# EasyEDA Pro project ProPrj_Starcat_FOC双路矢量控制器_2024-11-11.epro, schematic FOC_cdh_3

## Sheets
1 control: Board Name: 双路大功率矢量控制器_改动版; Create Date: 2024-07-31; Page Name: control; Project Name: Starcat_FOC双路矢量控制器; Schematic Name: FOC_cdh_3; Update Date: 2024-09-01
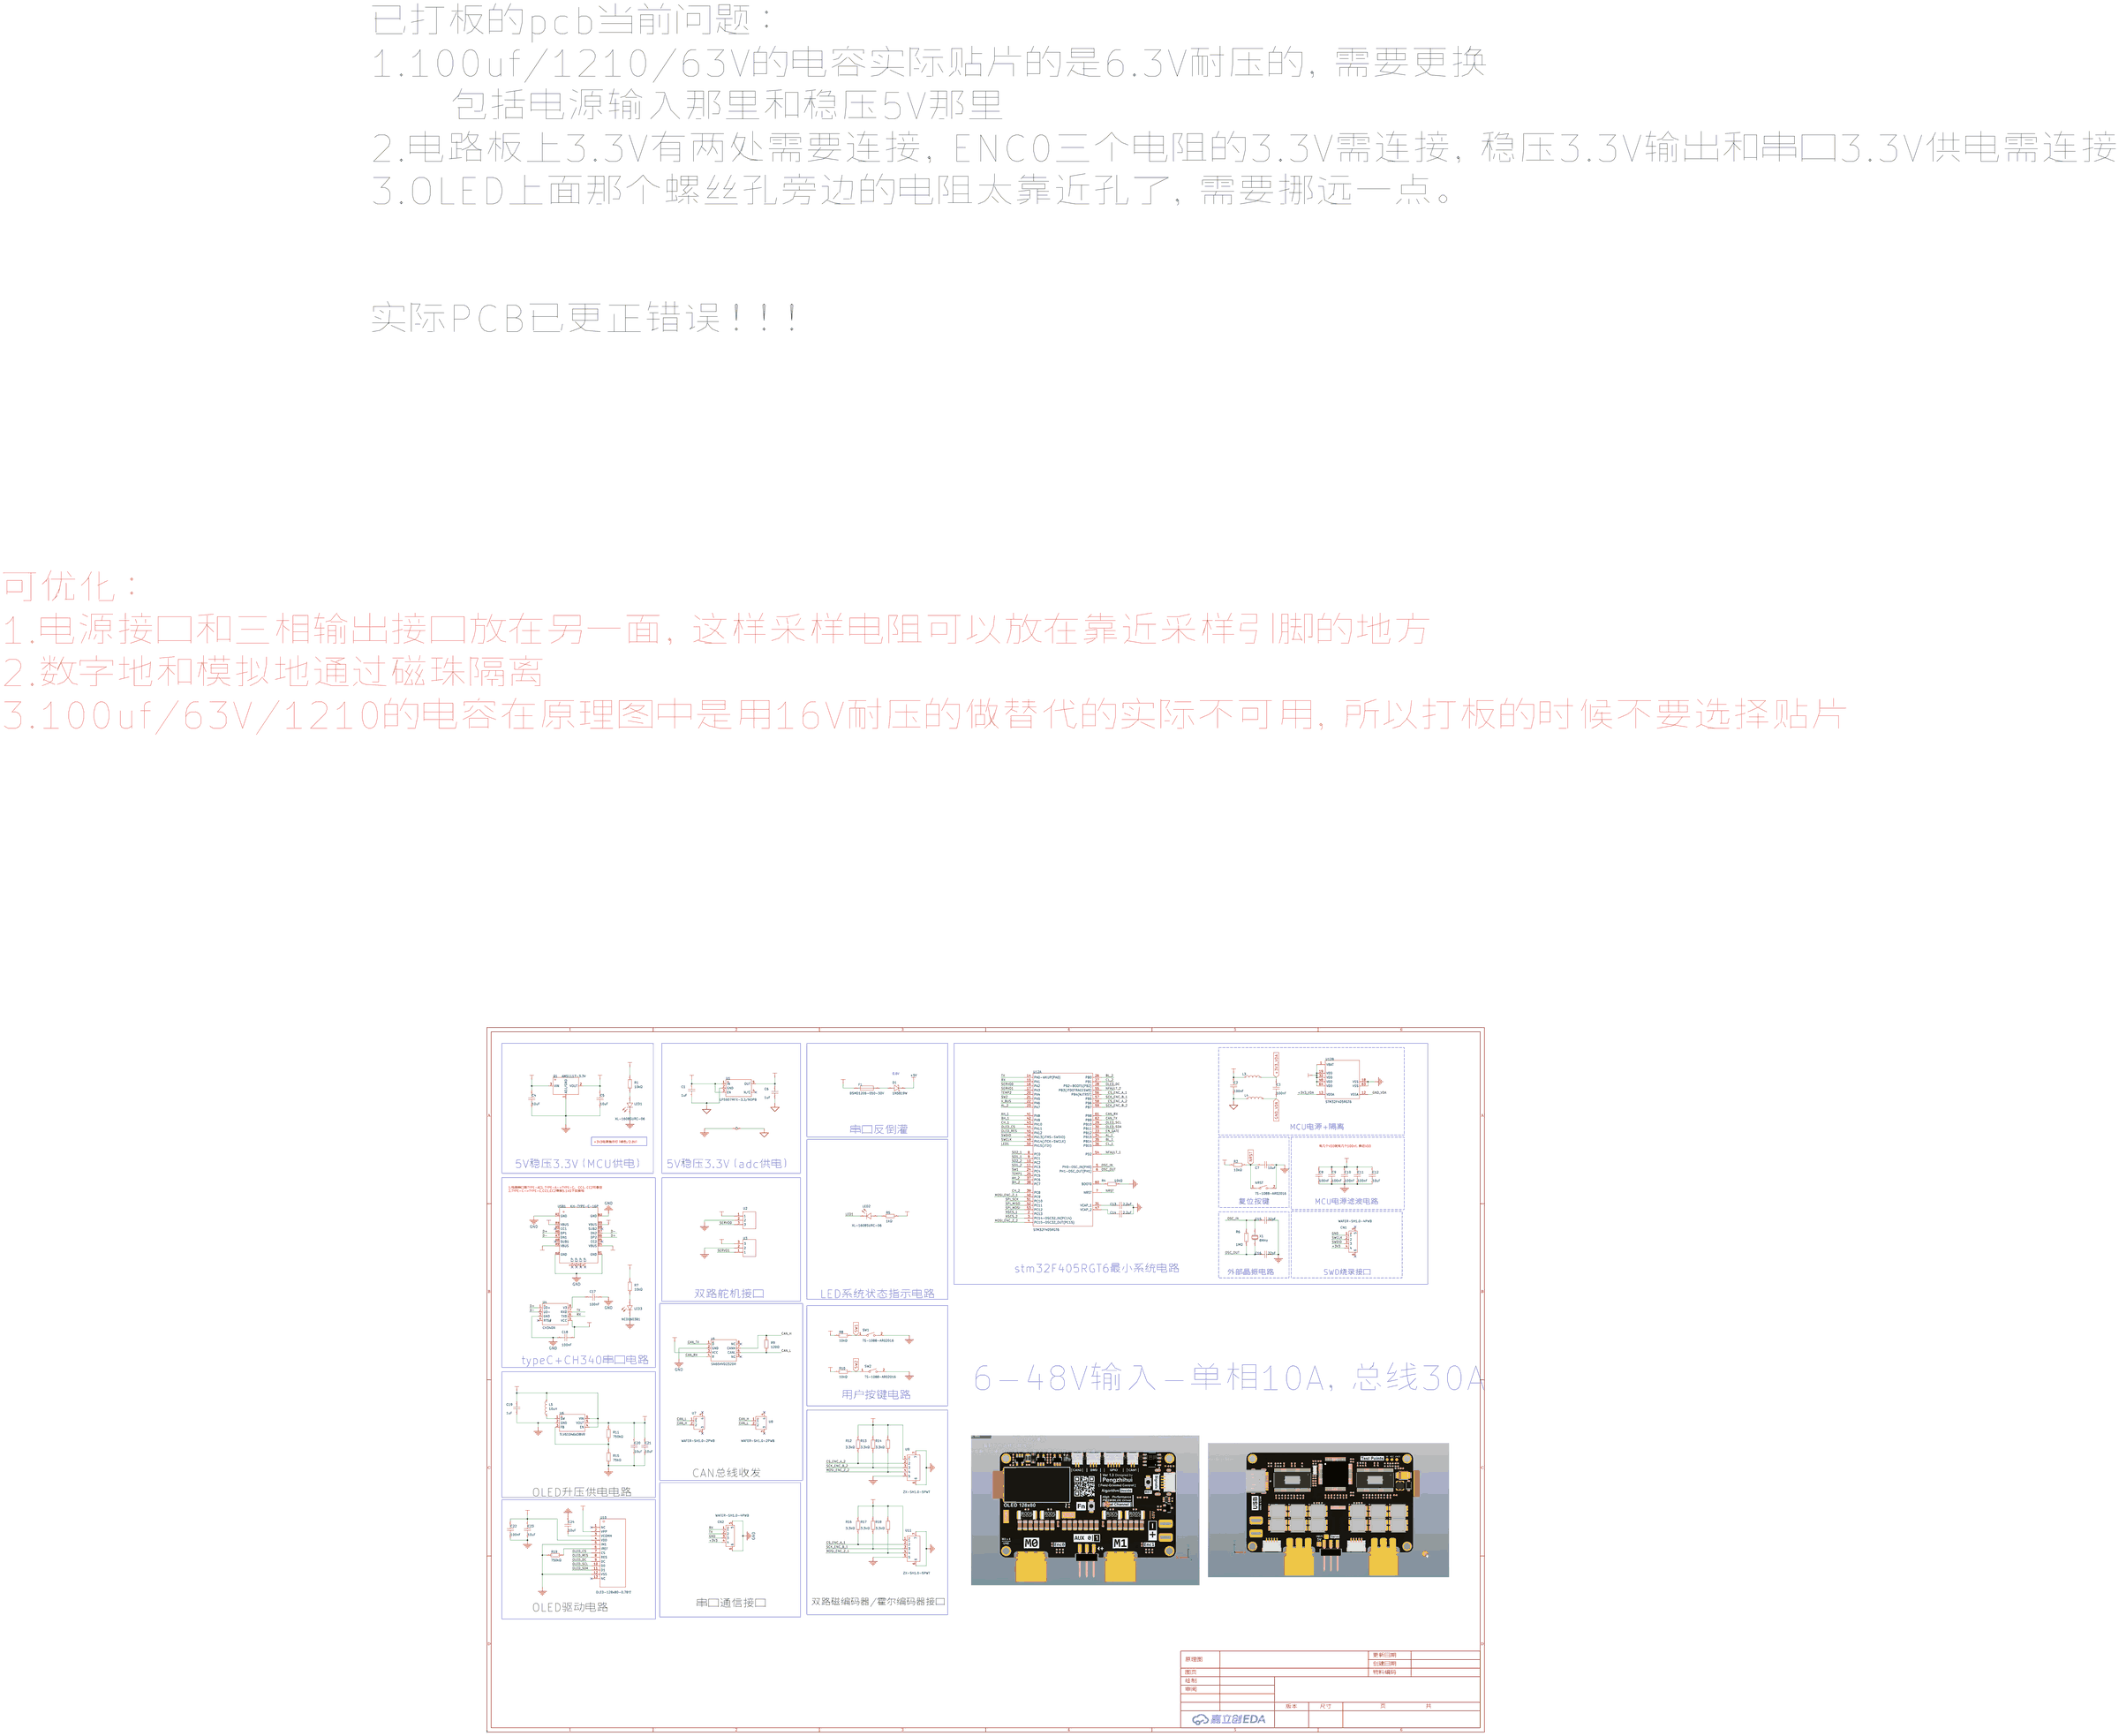
[diagram p3: control]
2 driver: Page Name: driver; Update Date: 2024-08-25
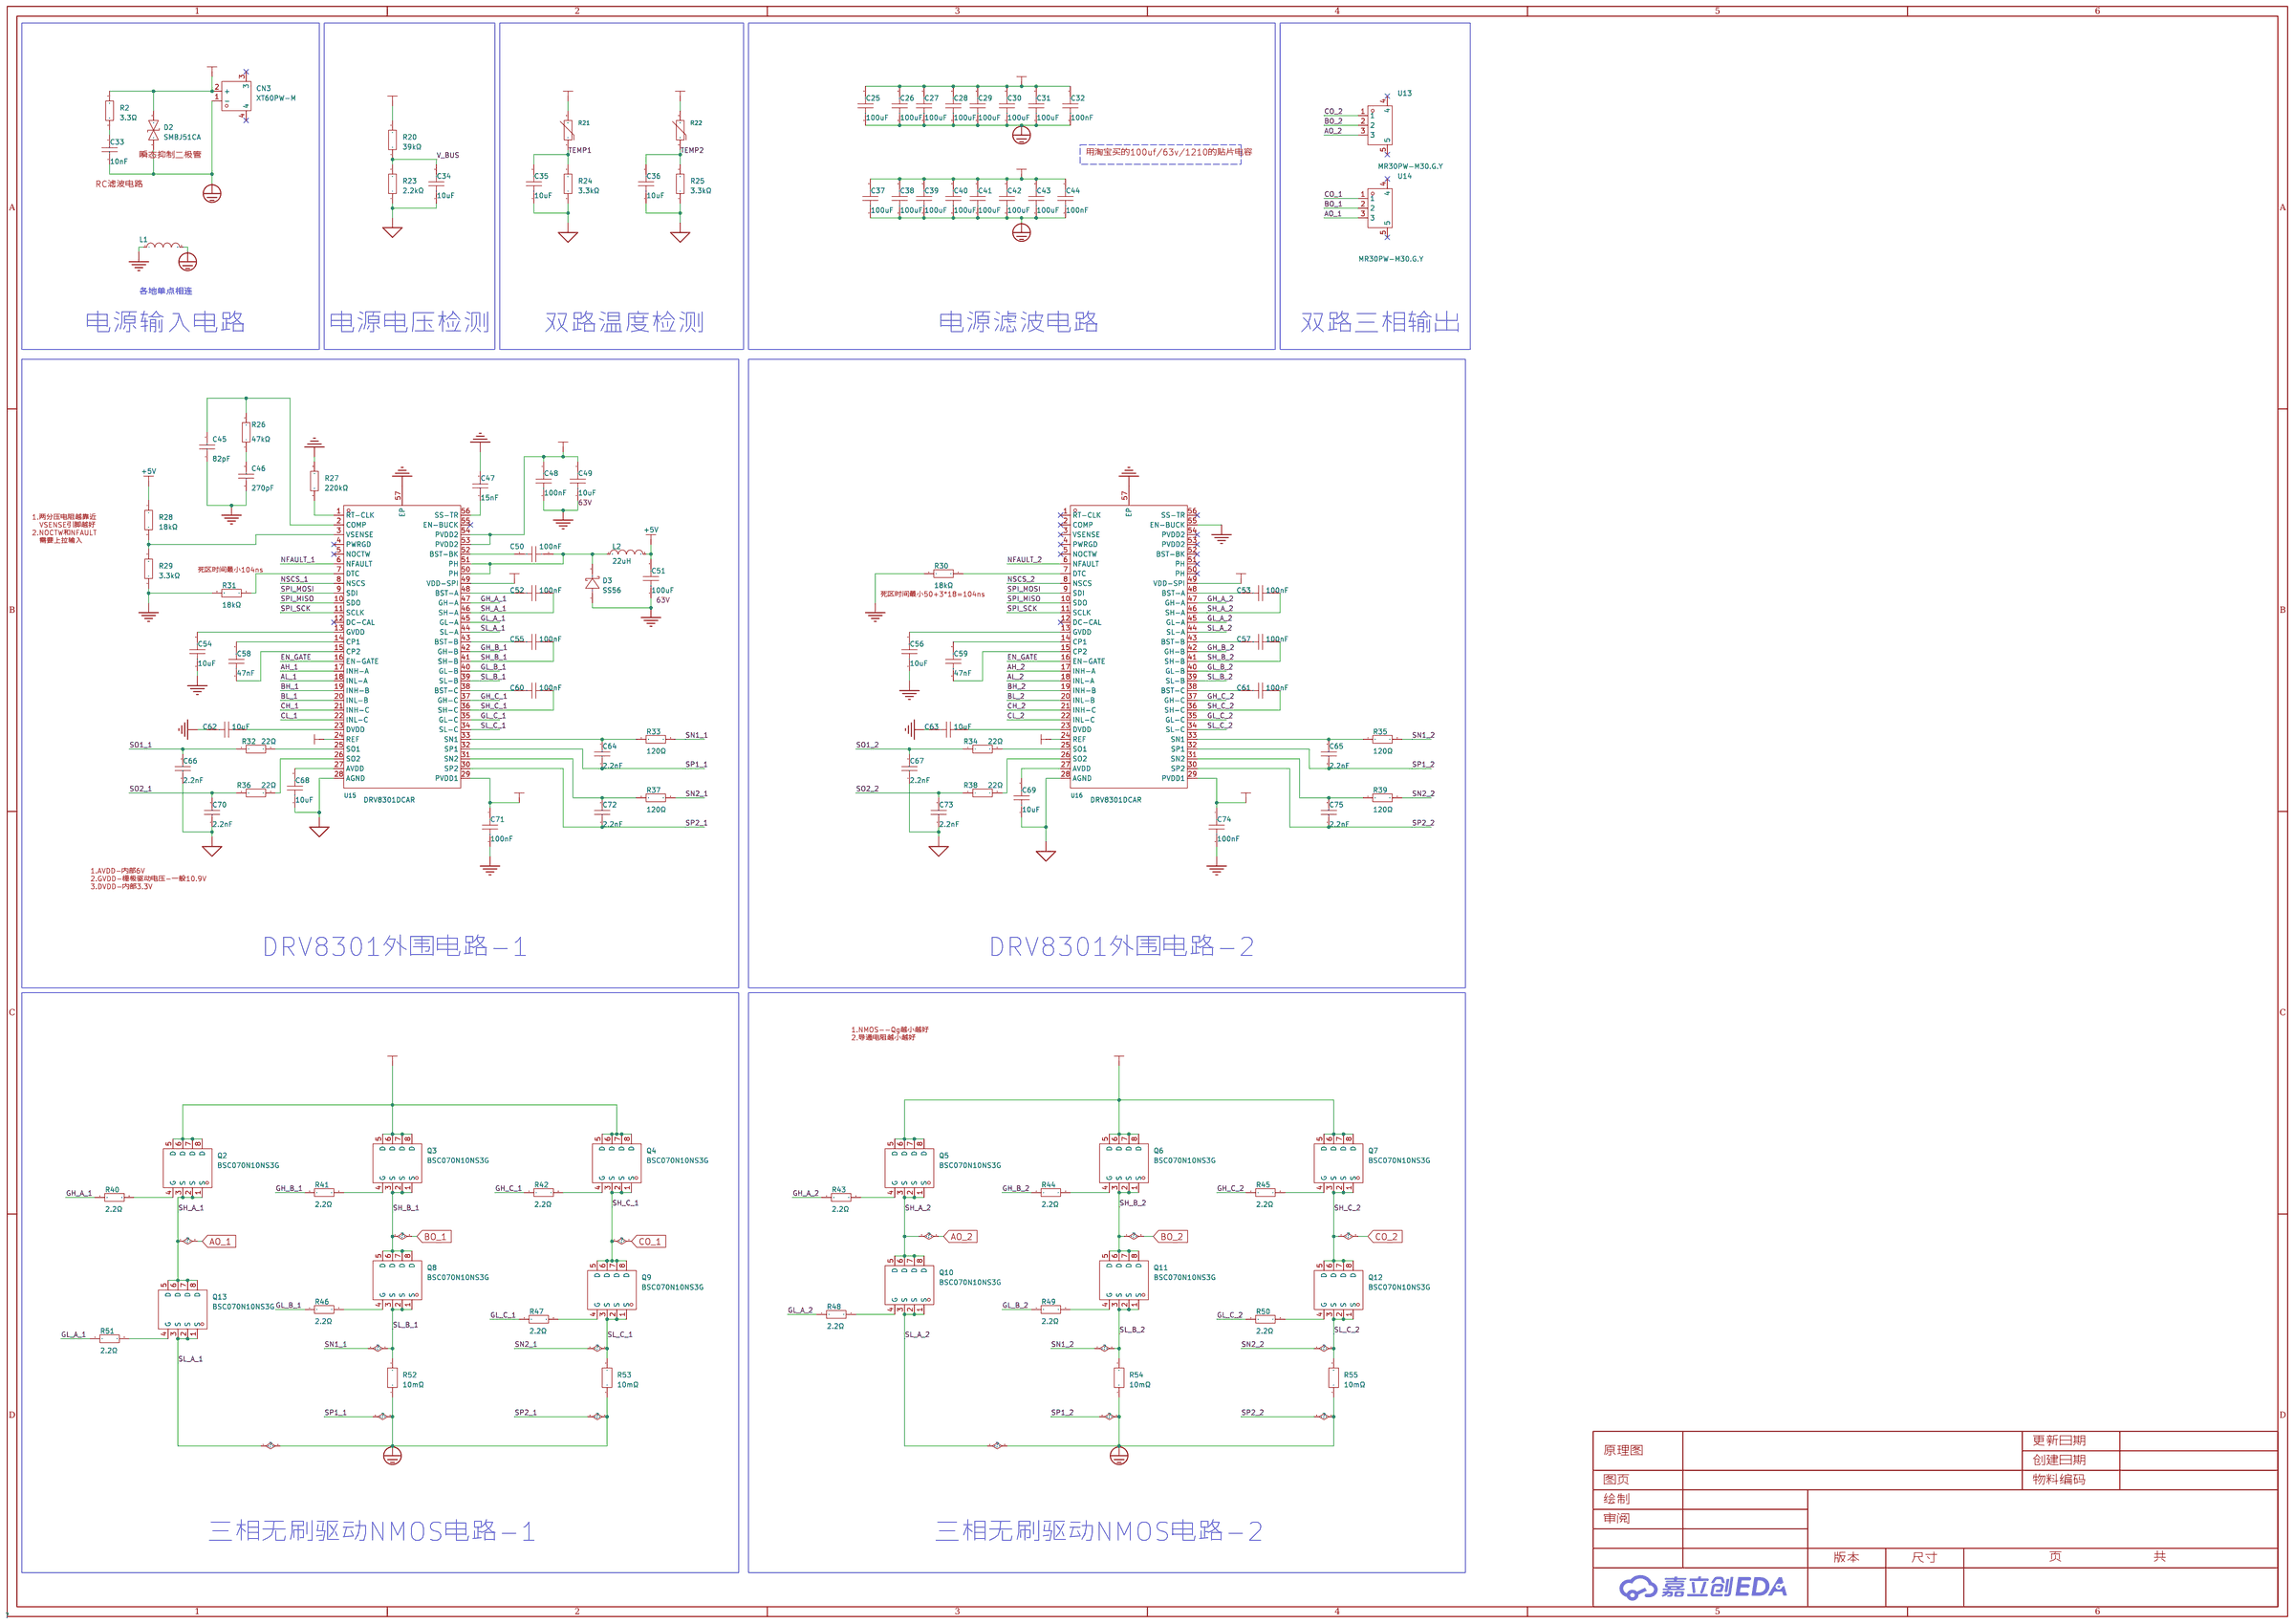
[diagram p4: driver]

## Parts
sheet control
C1  1uF  [C0603]
C2  100nF  [C0603]
C3  100nF  [C0603]
C4  10uF  [C0603]
C5  10uF  [C0603]
C6  1uF  [C0603]
C7  10uF  [C0603]
C8  100nF  [C0603]
C9  100nF  [C0603]
C10  100nF  [C0603]
C11  100nF  [C0603]
C12  10uF  [C0603]
C13  2.2uF  [C0603]
C14  2.2uF  [C0603]
C15  22pF  [C0603]
C16  22pF  [C0603]
C17  100nF  [C0603]
C18  100nF  [C0603]
C19  1uF  [C0603]
C20  10uF  [C0603]
C21  10uF  [C0603]
C22  100nF  [C0603]
C23  10uF  [C0603]
C24  10uF  [C0603]
CN1  WAFER-SH1.0-4PWB  [CONN-SMD_4P-P1.00_WAFER-SH1.0-4PWB]
CN2  WAFER-SH1.0-4PWB  [CONN-SMD_4P-P1.00_WAFER-SH1.0-4PWB]
D1  1N5819W  [SOD-123_L2.7-W1.6-LS3.7-R-RD]
F1  BSMD1206-050-30V  [F1206]
L3  CBG160808U000T  [L0603]
L4  CBG160808U000T  [L0603]
L5  10uH  [L0805]
LED1  XL-1608SURC-06  [LED0603-RD_RED]
LED2  XL-1608SURC-06  [LED0603-RD_RED]
LED3  NCD0603B1  [LED0603-RD]
NRST  TS-1088-AR02016  [SW-SMD_L3.9-W3.0-P4.45]
Q1  AMS1117-3.3V  [SOT-89-3_L4.5-W2.5-P1.50-LS4.2-BR]
R1  10kΩ  [R0603]
R3  10kΩ  [R0603]
R4  10kΩ  [R0603]
R5  1kΩ  [R0603]
R6  1MΩ  [R0603]
R7  10kΩ  [R0603]
R8  10kΩ  [R0603]
R9  120Ω  [R0603]
R10  10kΩ  [R0603]
R11  750kΩ  [R0603]
R12  3.3kΩ  [R0603]
R13  3.3kΩ  [R0603]
R14  3.3kΩ  [R0603]
R15  75kΩ  [R0603]
R16  3.3kΩ  [R0603]
R17  3.3kΩ  [R0603]
R18  3.3kΩ  [R0603]
R19  750kΩ  [R0603]
SW1  TS-1088-AR02016  [SW-SMD_L3.9-W3.0-P4.45]
SW2  TS-1088-AR02016  [SW-SMD_L3.9-W3.0-P4.45]
U1  LP5907MFX-3.3/NOPB  [SOT-23-5_L3.0-W1.7-P0.95-LS2.8-BR]
U2  -  [3p排针 贴片]
U3  -  [3p排针 贴片]
U4  CH340N  [SOP-8_L4.9-W3.9-P1.27-LS6.0-BL]
U5  SN65HVD232DR  [SOIC-8_L5.0-W4.0-P1.27-LS6.0-BL]
U6  TLV61046ADBVR  [SOT-23-6_L2.9-W1.6-P0.95-LS2.8-BL]
U7  WAFER-SH1.0-2PWB  [CONN-SMD_2P-P1.00_XUNPU_WAFER-SH1.0-2PWB]
U8  WAFER-SH1.0-2PWB  [CONN-SMD_2P-P1.00_XUNPU_WAFER-SH1.0-2PWB]
U9  ZX-SH1.0-5PWT  [CONN-SMD_5P-P1.00_MEGASTAR_ZX-SH1.0-5PWT]
U10  OLED-128x80-0.78寸  [oled-128x80-0.78寸]
U11  ZX-SH1.0-5PWT  [CONN-SMD_5P-P1.00_MEGASTAR_ZX-SH1.0-5PWT]
U12  STM32F405RGT6  [LQFP-64_L10.0-W10.0-P0.50-LS12.0-BL]  (sections 1,2)
USB1  KH-TYPE-C-16P  [USB-C-SMD_KH-TYPE-C-16P]
X1  8MHz  [CRYSTAL-SMD_L5.0-W3.2]
sheet driver
C25  100uF  [C1210]
C26  100uF  [C1210]
C27  100uF  [C1210]
C28  100uF  [C1210]
C29  100uF  [C1210]
C30  100uF  [C1210]
C31  100uF  [C1210]
C32  100nF  [C0603]
C33  10nF  [C0603]
C34  10uF  [C0603]
C35  10uF  [C0603]
C36  10uF  [C0603]
C37  100uF  [C1210]
C38  100uF  [C1210]
C39  100uF  [C1210]
C40  100uF  [C1210]
C41  100uF  [C1210]
C42  100uF  [C1210]
C43  100uF  [C1210]
C44  100nF  [C0603]
C45  82pF  [C0603]
C46  270pF  [C0603]
C47  15nF  [C0603]
C48  100nF  [C0603]
C49  10uF  [C0805]
C50  100nF  [C0603]
C51  100uF  [C1210]
C52  100nF  [C0603]
C53  100nF  [C0603]
C54  10uF  [C0603]
C55  100nF  [C0603]
C56  10uF  [C0603]
C57  100nF  [C0603]
C58  47nF  [C0603]
C59  47nF  [C0603]
C60  100nF  [C0603]
C61  100nF  [C0603]
C62  10uF  [C0603]
C63  10uF  [C0603]
C64  2.2nF  [C0603]
C65  2.2nF  [C0603]
C66  2.2nF  [C0603]
C67  2.2nF  [C0603]
C68  10uF  [C0603]
C69  10uF  [C0603]
C70  2.2nF  [C0603]
C71  100nF  [C0603]
C72  2.2nF  [C0603]
C73  2.2nF  [C0603]
C74  100nF  [C0603]
C75  2.2nF  [C0603]
CN3  XT60PW-M  [CONN-TH_XT60PW-M]
D2  SMBJ51CA  [SMB_L4.4-W3.6-LS5.4-BI]
D3  SS56  [SMA_L4.3-W2.6-LS5.0-FD]
L1  CBG160808U000T  [L0603]
L2  22uH  [IND-SMD_L4.0-W4.0]
Q2  BSC070N10NS3G  [PG-TDSON-8_L5.0-W6.0-P1.27-BL-EP]
Q3  BSC070N10NS3G  [PG-TDSON-8_L5.0-W6.0-P1.27-BL-EP]
Q4  BSC070N10NS3G  [PG-TDSON-8_L5.0-W6.0-P1.27-BL-EP]
Q5  BSC070N10NS3G  [PG-TDSON-8_L5.0-W6.0-P1.27-BL-EP]
Q6  BSC070N10NS3G  [PG-TDSON-8_L5.0-W6.0-P1.27-BL-EP]
Q7  BSC070N10NS3G  [PG-TDSON-8_L5.0-W6.0-P1.27-BL-EP]
Q8  BSC070N10NS3G  [PG-TDSON-8_L5.0-W6.0-P1.27-BL-EP]
Q9  BSC070N10NS3G  [PG-TDSON-8_L5.0-W6.0-P1.27-BL-EP]
Q10  BSC070N10NS3G  [PG-TDSON-8_L5.0-W6.0-P1.27-BL-EP]
Q11  BSC070N10NS3G  [PG-TDSON-8_L5.0-W6.0-P1.27-BL-EP]
Q12  BSC070N10NS3G  [PG-TDSON-8_L5.0-W6.0-P1.27-BL-EP]
Q13  BSC070N10NS3G  [PG-TDSON-8_L5.0-W6.0-P1.27-BL-EP]
R2  3.3Ω  [R0603]
R20  39kΩ  [R0603]
R21  NCP18XH103F03RB  [R0603]
R22  NCP18XH103F03RB  [R0603]
R23  2.2kΩ  [R0603]
R24  3.3kΩ  [R0603]
R25  3.3kΩ  [R0603]
R26  47kΩ  [R0603]
R27  220kΩ  [R0603]
R28  18kΩ  [R0603]
R29  3.3kΩ  [R0603]
R30  18kΩ  [R0603]
R31  18kΩ  [R0603]
R32  22Ω  [R0603]
R33  120Ω  [R0603]
R34  22Ω  [R0603]
R35  120Ω  [R0603]
R36  22Ω  [R0603]
R37  120Ω  [R0603]
R38  22Ω  [R0603]
R39  120Ω  [R0603]
R40  2.2Ω  [R0603]
R41  2.2Ω  [R0603]
R42  2.2Ω  [R0603]
R43  2.2Ω  [R0603]
R44  2.2Ω  [R0603]
R45  2.2Ω  [R0603]
R46  2.2Ω  [R0603]
R47  2.2Ω  [R0603]
R48  2.2Ω  [R0603]
R49  2.2Ω  [R0603]
R50  2.2Ω  [R0603]
R51  2.2Ω  [R0603]
R52  10mΩ  [RES-SMD_L6.4-W3.2-R2512]
R53  10mΩ  [RES-SMD_L6.4-W3.2-R2512]
R54  10mΩ  [RES-SMD_L6.4-W3.2-R2512]
R55  10mΩ  [RES-SMD_L6.4-W3.2-R2512]
U13  MR30PW-M30.G.Y  [CONN-TH_MR30PW-M30-G-Y]
U14  MR30PW-M30.G.Y  [CONN-TH_MR30PW-M30-G-Y]
U15  DRV8301DCAR  [HTSSOP-56_L14.0-W6.0-P0.50-LS8.0-BL]
U16  DRV8301DCAR  [HTSSOP-56_L14.0-W6.0-P0.50-LS8.0-BL]

## Library data of the parts
C1 C6 C19 = CL10A105KB8NNNC: 容值:1uF;精度:±10%;额定电压:50V;材质(温度系数):X5R;; LCSC Part Name: 1uF ±10% 50V; Supplier Part: C15849; Manufacturer: SAMSUNG(三星); Supplier Footprint: 0603; JLCPCB Part Class: 基础库; Datasheet: https://atta.szlcsc.com/upload/public/pdf/source/20160218/1457707763339.pdf; Supplier: LCSC; Tolerance: ±10%; Voltage Rated: 50V; Temperature Coefficient: X5R
C2 C3 C8-C11 C17 C18 C22 C32 C44 C48 C50 C52 C53 C55 C57 C60 C61 C71 C74 = 0603B104K101NT: 容值:100nF;精度:±10%;额定电压:100V;材质(温度系数):X7R;; LCSC Part Name: 100nF ±10% 100V; Supplier Part: C88219; Manufacturer: FH(风华); Supplier Footprint: 0603; JLCPCB Part Class: 扩展库; Datasheet: https://atta.szlcsc.com/upload/public/pdf/source/20200305/C486355_26A10D38EF8C2A5C37091D0039909270.pdf; Supplier: LCSC; Tolerance: ±10%; Voltage Rated: 100V; Temperature Coefficient: X7R
C4 C5 C7 C12 C20 C21 C23 C24 C34-C36 C54 C56 C62 C63 C68 C69 = CL10A106MA8NRNC: 容值:10uF;精度:±20%;额定电压:25V;材质(温度系数):X5R;; LCSC Part Name: 10uF ±20% 25V; Supplier Part: C96446; Manufacturer: SAMSUNG(三星); Supplier Footprint: 0603; JLCPCB Part Class: 基础库; Datasheet: https://atta.szlcsc.com/upload/public/pdf/source/20160218/1457707763339.pdf; Supplier: LCSC; Tolerance: ±20%; Voltage Rated: 25V; Temperature Coefficient: X5R
C13 C14 = CL10A225KQ8NNNC: 容值:2.2uF;精度:±10%;额定电压:6.3V;材质(温度系数):X5R;; LCSC Part Name: 2.2uF ±10% 6.3V; Supplier Part: C71000; Manufacturer: SAMSUNG(三星); Supplier Footprint: 0603; JLCPCB Part Class: 扩展库; Datasheet: https://atta.szlcsc.com/upload/public/pdf/source/20191106/C444885_D1DE823F0ED498E02883F0194C396E9C.pdf; Supplier: LCSC; Tolerance: ±10%; Voltage Rated: 6.3V; Temperature Coefficient: X5R
C15 C16 = CL10C220JB8NNNC: 容值:22pF;精度:±5%;额定电压:50V;材质(温度系数):C0G;; LCSC Part Name: 22pF ±5% 50V; Supplier Part: C1653; Manufacturer: SAMSUNG(三星); Supplier Footprint: 0603; JLCPCB Part Class: 基础库; Datasheet: https://atta.szlcsc.com/upload/public/pdf/source/20160218/1457707763339.pdf; Supplier: LCSC; Tolerance: ±5%; Voltage Rated: 50V; Temperature Coefficient: C0G
CN1 CN2 = WAFER-SH1.0-4PWB: 插针结构:1x4P;间距:1mm;安装方式:卧贴;总PIN数:4P;排数:1;每排PIN数:4;额定电流:1A;工作温度范围:-25℃~+85℃;; LCSC Part Name: 1x4P 间距:1mm 卧贴; Supplier Part: C3029343; Manufacturer: XUNPU(讯普); Supplier Footprint: SMD,P=1mm,卧贴; JLCPCB Part Class: 扩展库; Datasheet: https://atta.szlcsc.com/upload/public/pdf/source/20220527/1879B8210BD3B2006BCEAC1A40D397B6.pdf; Supplier: LCSC; Pins Structure: 1x4P; Pitch: 1mm; Mounting Style: 卧贴; Number of Pins: 4P; Number of Rows: 1; Number of PINs Per Row: 4; Current Rating (Max): 1A; Operating Temperature Range: -25℃~+85℃
D1 = 1N5819W_C963381: 二极管配置:独立式;正向压降(Vf):600mV@200mA;直流反向耐压(Vr):40V;平均整流电流(Io):350mA;; LCSC Part Name: 电压:40V 电流:350mA; Supplier Part: C963381; Manufacturer: JSMSEMI(杰盛微); Supplier Footprint: SOD-123; JLCPCB Part Class: 扩展库; Datasheet: https://atta.szlcsc.com/upload/public/pdf/source/20230807/ADD53622154D5B572F84A7B877E922CE.pdf; Supplier: LCSC; Diode Configuration: 独立式; Forward Voltage (Vf@If): 600mV@200mA; Reverse Voltage (Vr): 40V; Average Rectified Current (Io): 350mA; Reverse Leakage Current (Ir): 5uA@30V
F1 = BSMD1206-050-30V: 最大电压:30V;最大电流:40A;保持电流:500mA;跳闸电流:1A;; LCSC Part Name: 30V 500mA 1206自恢复; Supplier Part: C883126; Manufacturer: BHFUSE(佰宏); Supplier Footprint: 1206; JLCPCB Part Class: 扩展库; Datasheet: https://atta.szlcsc.com/upload/public/pdf/source/20230512/E419278EC8529AAF514173EF221BCF4B.pdf; Supplier: LCSC; Operating Voltage (Max): 30V; Current Rating (Max): 40A; Hold Current: 500mA; Trip Current: 1A; Power Dissipation: 800mW; Resistance - Initial (Ri) (Min): 150mΩ; Resistance - Post Trip (R1) (Max): 850mΩ; Maximum Time to Trip: 100ms; Operating Temperature: -40℃~+85℃
L1 L3 L4 = CBG160808U000T: 标称阻抗@测试频率:0Ω@100MHz;直流电阻(RDC):100mΩ;; LCSC Part Name: 单路 0603磁珠 阻抗0Ω@100MHz; Supplier Part: C43163; Manufacturer: FH(风华); Supplier Footprint: 0603; JLCPCB Part Class: 扩展库; Datasheet: https://atta.szlcsc.com/upload/public/pdf/source/20190129/C361667_1614D407CC98D1D3CFBD9E1F7511C14D.pdf; Supplier: LCSC; Impedance @ Frequency: 0Ω@100MHz; DC Resistance: 100mΩ; Current Rating: 800mA; Circuits: 1
L5 = SLM2012100MIT: 电感值:10uH;精度:±20%;额定电流:360mA;饱和电流(Isat):-;; LCSC Part Name: 10uH ±20%; Supplier Part: C2831365; Manufacturer: Sunltech(韩国顺磁); Supplier Footprint: 0805; JLCPCB Part Class: 扩展库; Datasheet: https://atta.szlcsc.com/upload/public/pdf/source/20180528/C216156_746607D01E5EB4C50E0D2BE40685D2FE.pdf; Supplier: LCSC; Tolerance: ±20%; Rated Current: 360mA; DC Resistance (DCR): 550mΩ
LED1 LED2 = XL-1608SURC-06: 发光颜色:红色;功率:55mW;正向电流:25mA;主波长:617nm~621nm;透镜颜色:无色透明透镜;色温:-;发光角度:120°;载带方式:正贴;工作温度:-30℃~+85℃;; Supplier Part: C965799; Manufacturer: XINGLIGHT(成兴光); Supplier Footprint: 0603; JLCPCB Part Class: 扩展库; Datasheet: https://atta.szlcsc.com/upload/public/pdf/source/20221102/D860AFDD1CDB02C5A8064103A32707E2.pdf; Supplier: LCSC; Emitted Color: 红色; Power Dissipation: 55mW; Forward Current: 25mA; Dominant Wavelength: 617nm~621nm; Peak Wavelength: 623nm; Lens Color: 无色透明透镜; Viewing Angle: 120°; Mounting Sytle: 正贴; Operating Temperature: -30℃~+85℃
LED3 = NCD0603B1: 发光颜色:蓝色;正向电压(VF):2.6V~3.6V;功率:72mW;正向电流:10mA;主波长:463nm~475nm;透镜颜色:无色透明透镜;发光强度:80mcd~220mcd;发光角度:130°;工作温度:-30℃~+85℃;; Supplier Part: C84266; Manufacturer: 国星光电; Supplier Footprint: 0603; JLCPCB Part Class: 扩展库; Datasheet: https://atta.szlcsc.com/upload/public/pdf/source/20200820/C84266_6A3CDBEFA72C6CAD68EDA53474ADAE6C.pdf; Supplier: LCSC; Emitted Color: 蓝色; Forward Voltage (VF): 2.6V~3.6V; Power Dissipation: 72mW; Forward Current: 10mA; Dominant Wavelength: 463nm~475nm; Lens Color: 无色透明透镜; Luminous Intensity: 80mcd~220mcd; Viewing Angle: 130°; Operating Temperature: -30℃~+85℃
NRST SW1 SW2 = TS-1088-AR02016: 电路结构:单刀单掷;按钮形状:圆形按钮;作用力:160gf;安装方式:立贴;开关长度:4mm;开关宽度:3mm;开关高度:2mm;带支架:不带;触点电流:50mA;额定电压(DC):12V;绝缘电阻:100MΩ;机械寿命:10万次;; LCSC Part Name: 4*3*2mm 立贴 轻触开关; Supplier Part: C720477; Manufacturer: XUNPU(讯普); Supplier Footprint: SMD; JLCPCB Part Class: 扩展库; Datasheet: https://atta.szlcsc.com/upload/public/pdf/source/20200810/C720475_60D09DD6C54279ADDB2DC25100F1CC11.pdf; Supplier: LCSC; Circuit: 单刀单掷; Actuator Style: 圆形按钮; Operating Force: 160gf; Mounting Style: 立贴; Switch Length: 4mm; Switch Width: 3mm; Switch Height: 2mm; Strike Gundam: 不带; Contact Current: 50mA; Voltage Rating (DC): 12V; Insulation Resistance: 100MΩ; Actuator/Cap Color: 黑色; Pin Style: SMD接片; Mechanical Life: 10万次; Operating Temperature: -30℃~+80℃
Q1 = AMS1117-3.3V_C5120796: 输出类型:固定;输出极性:正;最大输入电压:18V;输出电压:3.3V;输出电流:1A;; Supplier: LCSC; Supplier Part: C5120796; Manufacturer: MSKSEMI(美森科); JLCPCB Part Class: 扩展库; LCSC Part Name: 输入18V 输出3.3V 1A; Supplier Footprint: SOT-89; Datasheet: https://atta.szlcsc.com/upload/public/pdf/source/20230802/A3918E880B22D5DA08FB6633703CD81C.pdf; Output Type: 固定; Output Polarity: 正; Number of Outputs: 1; Maximum Input Voltage: 18V; Output Voltage: 3.3V; Dropout Voltage: 1.4V@(1A); Quiescent Current (Ground Current): 12mA; Output Current: 1A; Operating Temperature: 0℃~+125℃
R1 R3 R4 R7 R8 R10 = 0603WAF1002T5E: 电阻类型:厚膜电阻;阻值:10kΩ;精度:±1%;功率:100mW;最大工作电压:75V;温度系数:±100ppm/℃;; LCSC Part Name: 厚膜电阻 10kΩ ±1% 100mW; Supplier Part: C25804; Manufacturer: UNI-ROYAL(厚声); Supplier Footprint: 0603; JLCPCB Part Class: 基础库; Datasheet: https://atta.szlcsc.com/upload/public/pdf/source/20200306/C422600_1E6D84923E4A46A82E41ADD87F860B5C.pdf; Supplier: LCSC; Type: 厚膜电阻; Tolerance: ±1%; Power(Watts): 100mW; Overload Voltage (Max): 75V; Temperature Coefficient: ±100ppm/℃; Operating Temperature Range: -55℃~+155℃
R5 = 0603WAF1001T5E: 电阻类型:厚膜电阻;阻值:1kΩ;精度:±1%;功率:100mW;最大工作电压:75V;温度系数:±100ppm/℃;; LCSC Part Name: 1kΩ ±1% 100mW 厚膜电阻; Supplier Part: C21190; Manufacturer: UNI-ROYAL(厚声); Supplier Footprint: 0603; JLCPCB Part Class: 基础库; Datasheet: https://atta.szlcsc.com/upload/public/pdf/source/20200306/C422600_1E6D84923E4A46A82E41ADD87F860B5C.pdf; Supplier: LCSC; Type: 厚膜电阻; Tolerance: ±1%; Power(Watts): 100mW; Overload Voltage (Max): 75V; Temperature Coefficient: ±100ppm/℃; Operating Temperature Range: -55℃~+155℃
R6 = 0603WAF1004T5E: 电阻类型:厚膜电阻;阻值:1MΩ;精度:±1%;功率:100mW;最大工作电压:75V;温度系数:±100ppm/℃;; LCSC Part Name: 1MΩ ±1% 100mW 厚膜电阻; Supplier Part: C22935; Manufacturer: UNI-ROYAL(厚声); Supplier Footprint: 0603; JLCPCB Part Class: 基础库; Datasheet: https://atta.szlcsc.com/upload/public/pdf/source/20200306/C422600_1E6D84923E4A46A82E41ADD87F860B5C.pdf; Supplier: LCSC; Type: 厚膜电阻; Tolerance: ±1%; Power(Watts): 100mW; Overload Voltage (Max): 75V; Temperature Coefficient: ±100ppm/℃; Operating Temperature Range: -55℃~+155℃